# EasyEDA Pro project Dart25-有控镖航电系统.eprj, schematic Schematic6
Company: 嘉立创EDA; Page Size: A4; Version: V1.0
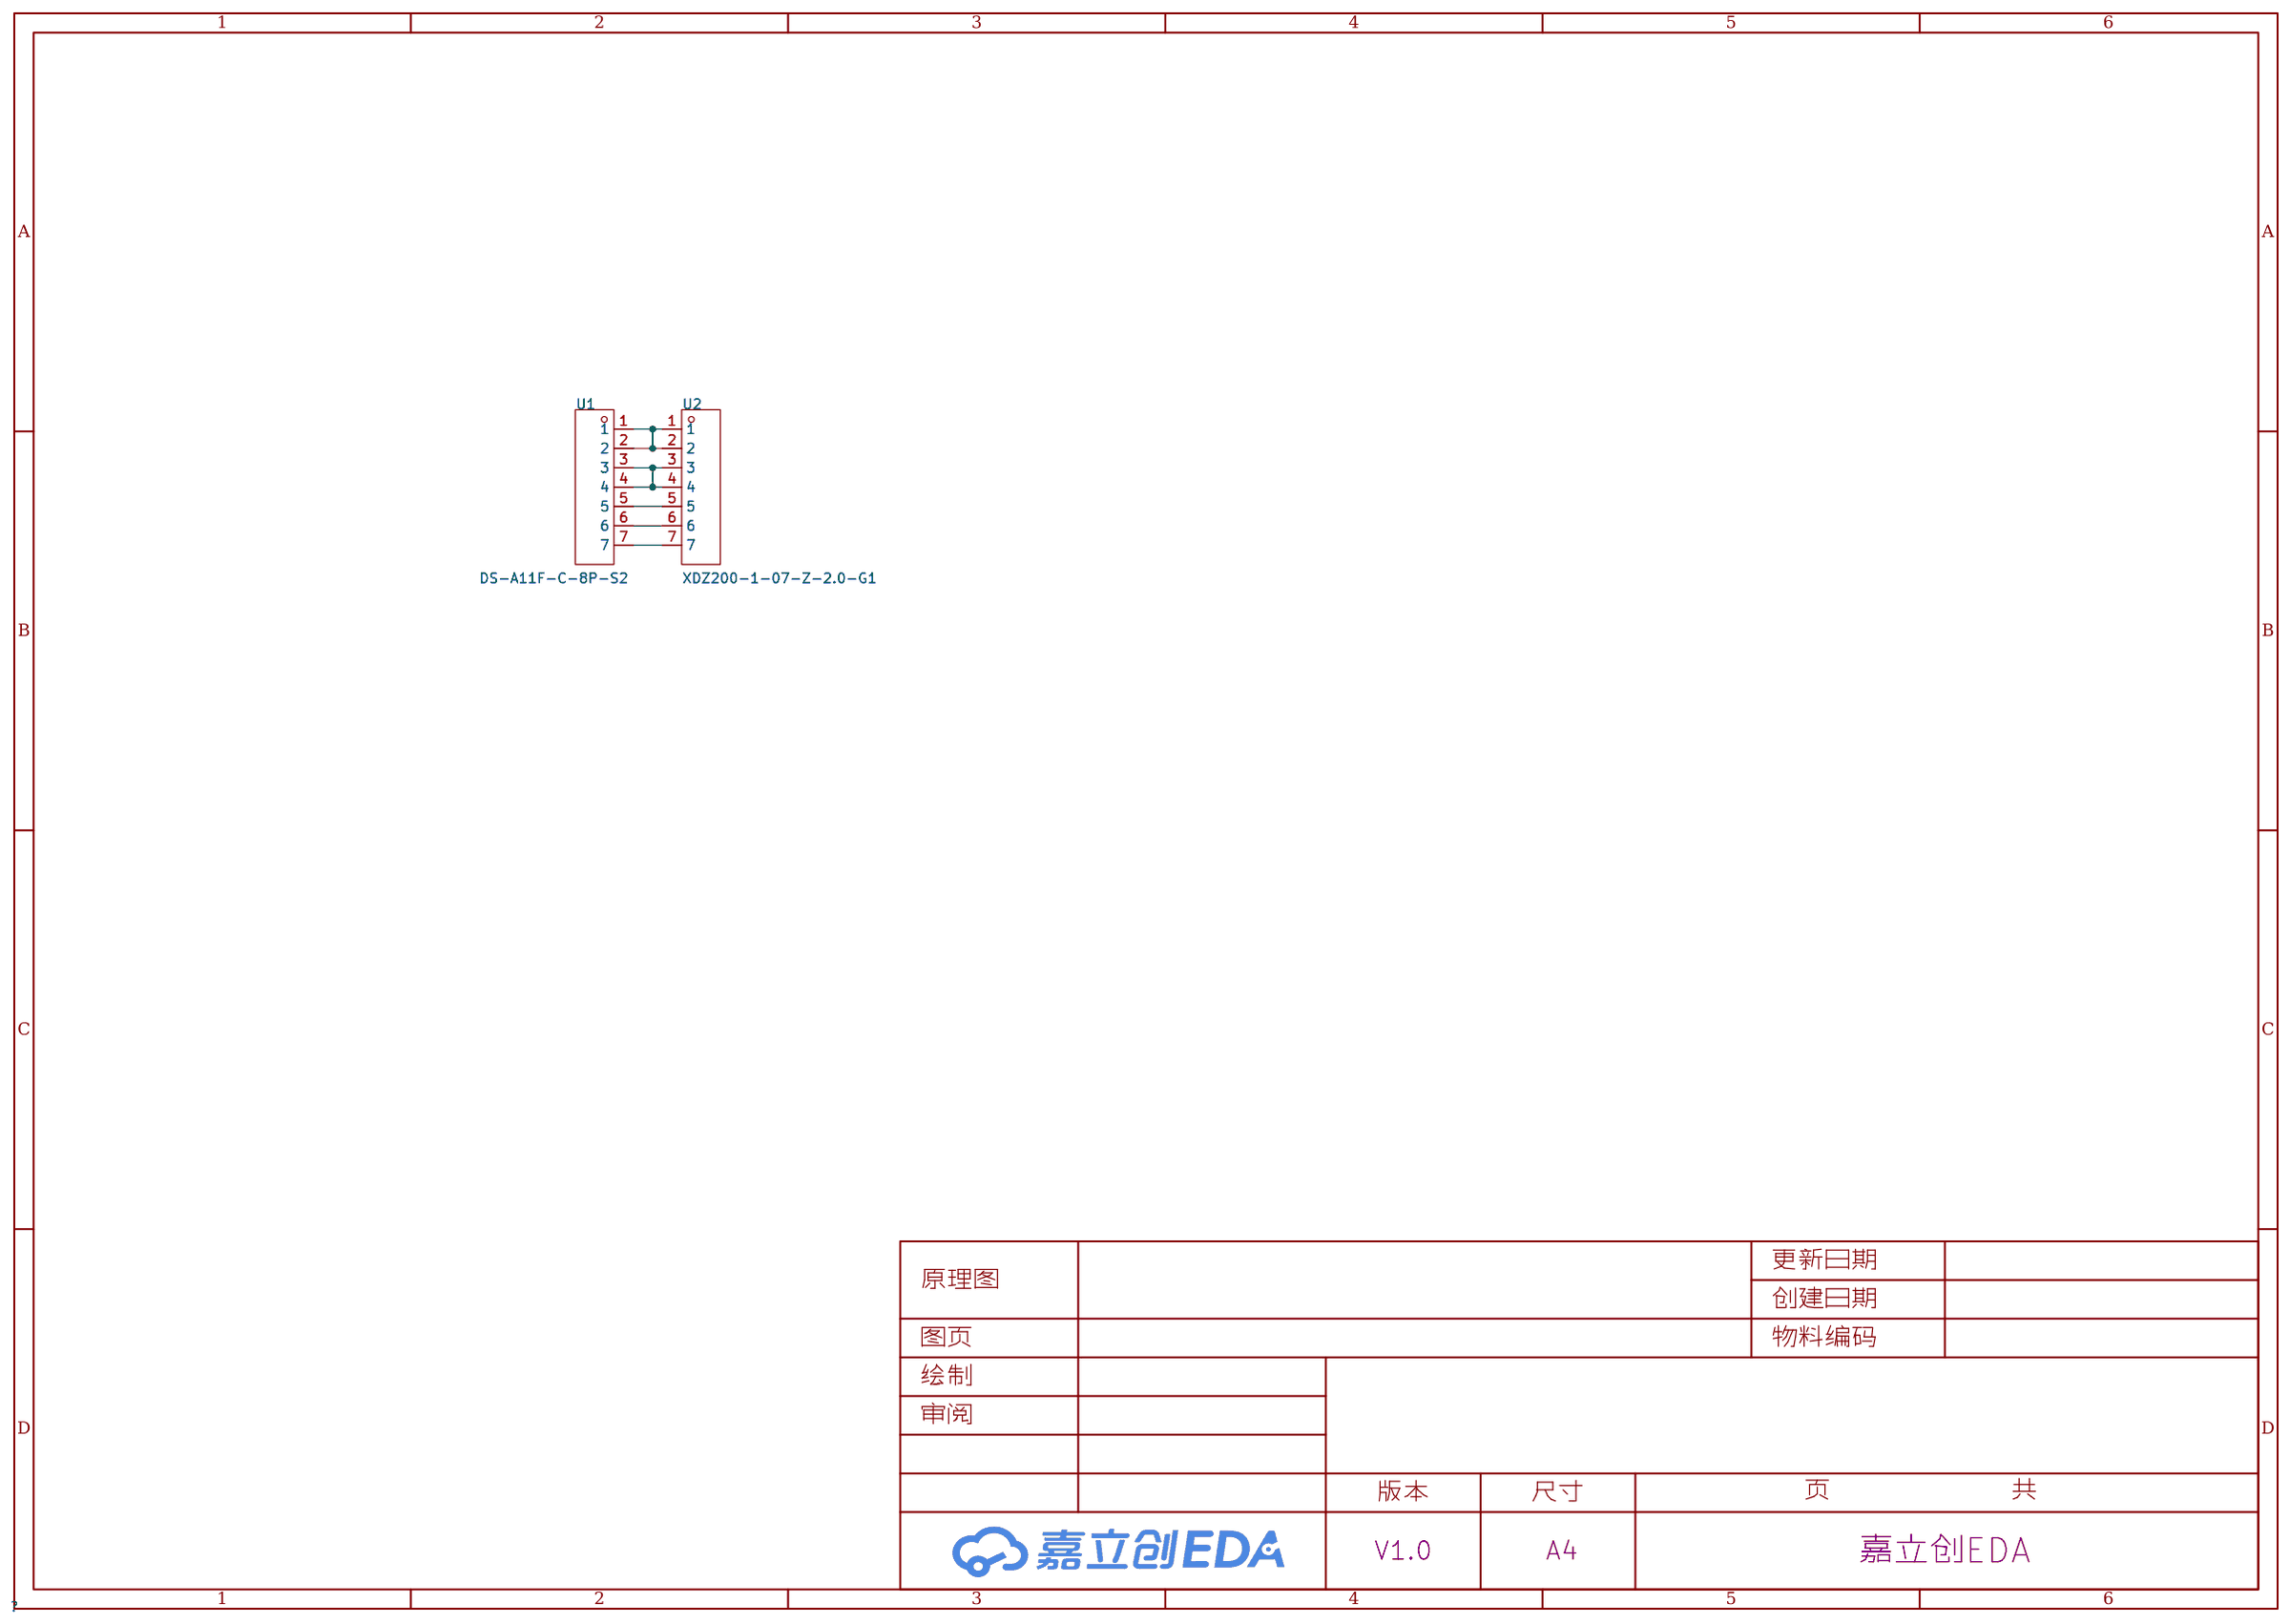
[diagram p4: schematic sheet]

## Parts
U1  DS-A11F-C-8P-S2  [CONN-TH_8P-P2.00_DS-A11F-C-7P-L1]
U2  XDZ200-1-07-Z-2.0-G1  [HDR-TH_7P-P2.00-V-M]

## Library data of the parts
U1 = DS-A11F-C-7P-L1: Supplier Part: C9900094989; JLCPCB Part Class: 扩展库; Supplier: LCSC
U2 = XDZ200-1-07-Z-2.0-G1: 插针结构:1x7P;间距:2mm;圆针/方针:方针;安装类型:直插;排数:单排;总PIN位数:7P;额定电流:1.5A;配合针长度:3.9mm;塑高:2mm;端接针长度:2.8mm;触头镀层:金;工作温度范围:-40℃~+105℃;颜色:黑色;; LCSC Part Name: 1x7P 间距:2mm 直插 方针; Supplier Part: C19190943; Manufacturer: XUNDA(讯答); Supplier Footprint: 插件,P=2mm; JLCPCB Part Class: Extended Part; Datasheet: https://atta.szlcsc.com/upload/public/pdf/source/20231109/3E6501A16770CD5922763E41CE42EA59.pdf; Supplier: LCSC; Pin Structure: 1x7P; Pitch: 2mm; Circluar Pins/Square Pins: 方针; Mounting Type: 直插; Number of Rows: 单排; Number of Pins: 7P; Current Rating (Max): 1.5A; Length of Mating Pin: 3.9mm; Insulation Height: 2mm; Length of End Connection Pin: 2.8mm; Contact Plating: 金; Operating Temperature Range: -40℃~+105℃; Color: 黑色

## Nets
$1N148: U1.5 U2.5
$1N150: U1.6 U2.6
$1N152: U1.7 U2.7
$1N156: U1.1 U1.2 U2.1 U2.2
$1N166: U1.3 U1.4 U2.3 U2.4
